# EasyEDA Pro project 电子指南针-git.eprj, board PCB6
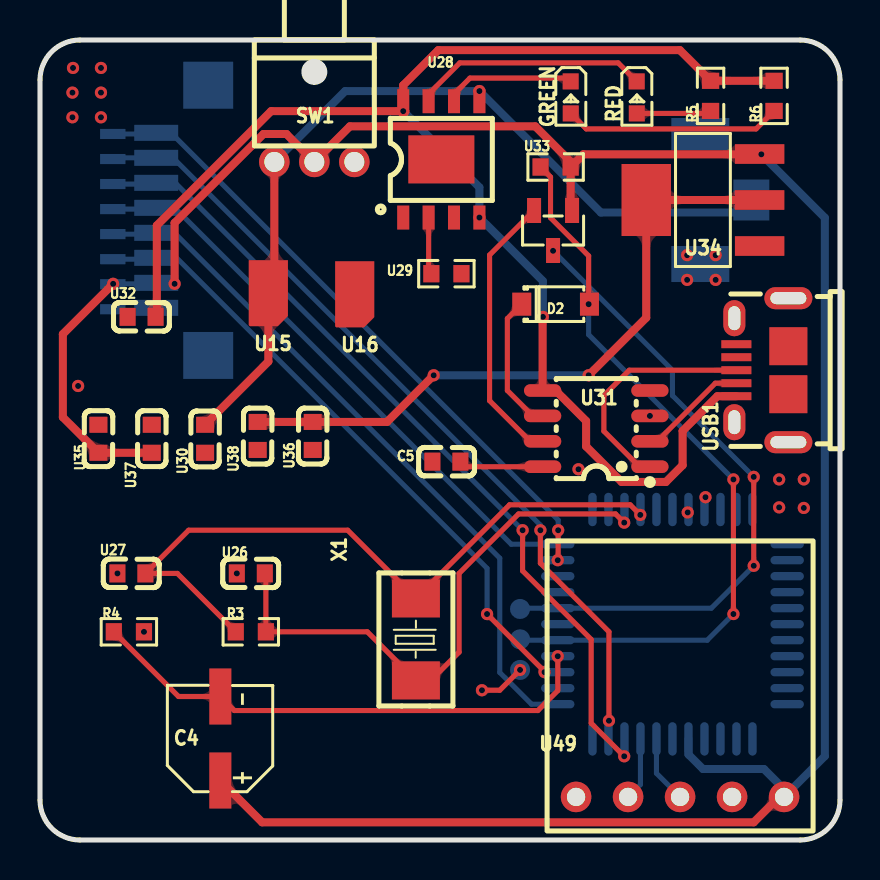
[diagram p2: board, top side]
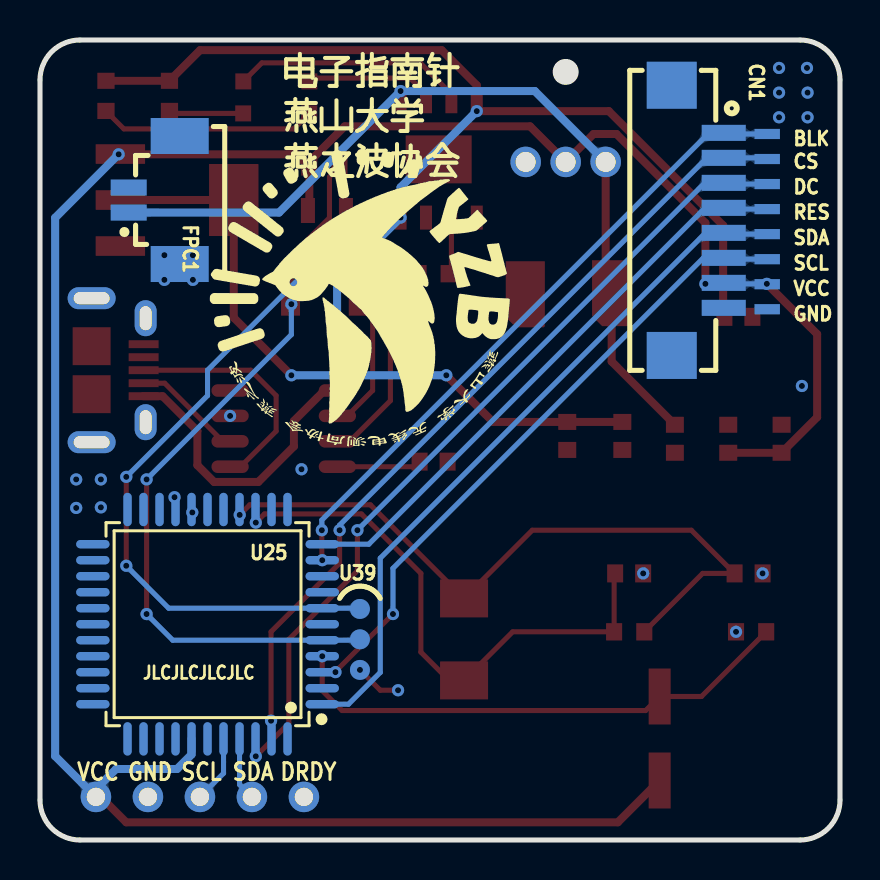
[diagram p3: board, bottom side, seen from below]

Outline 40 x 40 mm; copper layers: Top Layer, Bottom Layer. Coordinates in mm from the lower left corner of the outline.
Outline path: 0,38 0,2 arc(0.59,0.59) 2,0 38,0 arc(39.41,0.59) 40,2 40,38 arc(39.41,39.41) 38,40 2,40 arc(0.59,39.41) 0,38
Stack: Top Layer 0.035mm / Dielectric1 1.51mm FR4 er 4.5 / Bottom Layer 0.035mm

## Design rules (mm)
template: JLCPCB Capability(Two Layers Board)
spacing copperThickness1oz (default): track to track 0.102, other pairs 0.152 to 0.3
spacing copperThickness2oz: track to track 0.203, other pairs 0.152 to 0.3
track width copperThickness1oz (default): min 0.127, default 0.254, max 2.54
track width copperThickness2oz: min 0.203, default 0.254, max 2.54
differential pair differentialPair (default): width min 0.127, default 0.254, max 2.54; gap min 0.152, default 0.152
via viaSize (default): diameter min 0.5, default 0.61, max 10; hole min 0.3, default 0.305, max 6.3

## Placement (name value [footprint] x y rotation side)
BLK  -  [mini焊盘]  3.64 35.3 180 bottom
C4  10uF  [CAP-SMD_BD5.0-L5.3-W5.3-FD]  9.02 5.07 90 top
C5  100nF  [C0603]  20.32 18.92 180 top
CN1  HC-1.25-8PWT  [CONN-SMD_HC-1.25-8PWT]  7.11 30.98 270 bottom
CS  -  [mini焊盘]  3.64 34.05 180 bottom
D2  MBR0520  [SOD-123_L2.8-W1.8-LS3.7-RD]  25.78 26.79 0 top
DC  -  [mini焊盘]  3.64 32.8 180 bottom
FPC1  1.25-2PWB  [CONN-SMD_2P-P1.25_DEALON_1.25-2PWB]  34.29 32 90 bottom
GND  -  [mini焊盘]  3.64 26.54 180 bottom
GREEN  -  [LED_0603]  26.54 37.08 270 top
Q2  2SK3018  [SOT-23-3_L2.9-W1.3-P1.90-LS2.4-BR]  25.65 30.47 90 top
R3  10K  [R0603]  10.54 10.41 0 top
R4  10K  [R0603]  4.44 10.41 180 top
R5  2kΩ  [R0603]  33.53 37.21 90 top
R6  2kΩ  [R0603]  36.7 37.21 90 top
RED  -  [LED_0603]  29.84 37.08 270 top
RES  -  [mini焊盘]  3.64 31.55 180 bottom
SCL  -  [mini焊盘]  3.64 29.04 180 bottom
SDA  -  [mini焊盘]  3.64 30.29 180 bottom
SW1  XKB5858-Z-C  [SW-TH_XKB5858-Z-C]  13.72 33.9 0 top
U15  -  [小焊盘]  11.38 27.72 180 top
U16  -  [小焊盘]  15.7 27.67 180 top
U25  STC89C52RC-40I-LQFP44  [LQFP-44_L10.0-W10.0-P0.80-LS12.0-BL]  31.62 10.79 90 bottom
U26  30pF  [C0603]  10.54 13.33 0 top
U27  30pF  [C0603]  4.57 13.33 0 top
U28  TP4056  [ESOP-8_L4.9-W3.9-P1.27-LS6.0-BL-EP]  20.07 34.03 0 top
U29  1.2kΩ  [R0603]  20.32 28.32 180 top
U30  10uF  [C0603]  8.25 20.06 90 top
U31  CH340N  [SOP-8_L4.9-W3.9-P1.27-LS6.0-BL]  27.81 20.57 90 top
U32  10uF  [C0603]  5.08 26.16 0 top
U33  2kΩ  [R0603]  25.78 33.65 0 top
U34  SK12D07VG3  [SOT-223-4_L6.5-W3.5-P2.30-LS7.0-BR]  33.15 32 0 top
U35  10uF  [C0603]  2.92 20.06 270 top
U36  10uF  [C0603]  13.64 20.2 90 top
U37  1.5pF  [C0603]  5.59 20.06 270 top
U38  1.5pF  [C0603]  10.88 20.2 90 top
U39  -  [下载调试点]  24 11.04 180 bottom
U49  -  [5插件焊盘 间距2.6mm]  32 2.15 0 top
USB1  U254-051N-4BH24-S2S  [MICRO-USB-SMD_U254-051N-4BH24-S2]  36.07 23.49 90 top
VCC  -  [mini焊盘]  3.64 27.79 180 bottom
X1  11.0592MHz  [OSC-SMD_L5.0-W3.2]  18.8 10.03 270 top

## Footprints (pads in the part's own frame, mm; a bottom-side part is the same pattern mirrored in y, then rotated)
5插件焊盘 间距2.6mm
  round 1.524 hole 0.914: 1(-5.2,0) 2(-2.6,0) 3(0,0) 4(2.6,0) 5(5.2,0)
C0603
  rect 0.8x0.9 smd: 1(-0.7,0) 2(0.7,0)
CAP-SMD_BD5.0-L5.3-W5.3-FD
  rect 2.8x1.1 smd: 1(-2.1,0) 2(2.1,0)
CONN-SMD_2P-P1.25_DEALON_1.25-2PWB
  rect 0.8x1.8 smd: 1(-0.625,1.275) 2(0.625,1.275)
  rect 1.8x2.9 smd: 3(-3.2,-1.275) 4(3.2,-1.275)
CONN-SMD_HC-1.25-8PWT
  rect 0.8x2.2 smd: 1(-4.375,1.3) 2(-3.125,1.3) 3(-1.875,1.3) 4(-0.625,1.3) 5(0.625,1.3) 6(1.875,1.3) 7(3.125,1.3) 8(4.375,1.3)
  rect 2.35x2.5 smd: 9(-6.755,-1.3) 10(6.755,-1.3)
ESOP-8_L4.9-W3.9-P1.27-LS6.0-BL-EP
  rect 0.6x1.2 smd: 1(-1.905,-2.909) 2(-0.635,-2.909) 3(0.635,-2.909) 4(1.905,-2.909) 5(1.905,2.909) 6(0.635,2.909) 7(-0.635,2.909) 8(-1.905,2.909)
  rect 3.3x2.4 smd: 9(0,0)
LED_0603
  rect 0.8x0.8 smd: 1(-0.851,-0.01) 2(0.75,-0.005)
LQFP-44_L10.0-W10.0-P0.80-LS12.0-BL
  oval 0.42x1.67 smd: 1(-4,-5.735) 2(-3.2,-5.735) 3(-2.4,-5.735) 4(-1.6,-5.735) 5(-0.8,-5.735) 6(0,-5.735) 7(0.8,-5.735) 8(1.6,-5.735) 9(2.4,-5.735) 10(3.2,-5.735) 11(4,-5.735) 23(4,5.735) 24(3.2,5.735) 25(2.4,5.735) 26(1.6,5.735) 27(0.8,5.735) 28(0,5.735) 29(-0.8,5.735) 30(-1.6,5.735) 31(-2.4,5.735) 32(-3.2,5.735) 33(-4,5.735)
  oval 1.67x0.42 smd: 12(5.735,-4) 13(5.735,-3.2) 14(5.735,-2.4) 15(5.735,-1.6) 16(5.735,-0.8) 17(5.735,0) 18(5.735,0.8) 19(5.735,1.6) 20(5.735,2.4) 21(5.735,3.2) 22(5.735,4) 34(-5.735,4) 35(-5.735,3.2) 36(-5.735,2.4) 37(-5.735,1.6) 38(-5.735,0.8) 39(-5.735,0) 40(-5.735,-0.8) 41(-5.735,-1.6) 42(-5.735,-2.4) 43(-5.735,-3.2) 44(-5.735,-4)
MICRO-USB-SMD_U254-051N-4BH24-S2
  rect 0.4x1.5 smd: 1(-1.3,1.25) 2(-0.65,1.25) 3(0,1.25) 4(0.65,1.25) 5(1.3,1.25)
  oval 1.1x2.4 hole 0.6x1.8: 6(-3.6,-1.35) 6(3.6,-1.35)
  oval 1.8x1.1 hole 1.2x0.6: 6(-2.6,1.35) 6(2.6,1.35)
  rect 1.9x1.9 smd: 6(-1.2,-1.35) 6(1.2,-1.35)
mini焊盘
  custom 1.27x0.508 smd: 1(0,0)
OSC-SMD_L5.0-W3.2
  rect 1.9x2.4 smd: 1(-2.05,0) 2(2.05,0)
R0603
  rect 0.806x0.864 smd: 1(-0.753,0) 2(0.753,0)
SOD-123_L2.8-W1.8-LS3.7-RD
  rect 0.95x1.15 smd: 1(-1.692,0) 2(1.692,0)
SOP-8_L4.9-W3.9-P1.27-LS6.0-BL
  oval 0.63x1.865 smd: 1(-1.905,-2.683) 2(-0.635,-2.683) 3(0.635,-2.683) 4(1.905,-2.683) 5(1.905,2.683) 6(0.635,2.683) 7(-0.635,2.683) 8(-1.905,2.683)
SOT-23-3_L2.9-W1.3-P1.90-LS2.4-BR
  rect 1.25x0.7 smd: 1(1,-0.95) 2(1,0.95) 3(-1,0)
SOT-223-4_L6.5-W3.5-P2.30-LS7.0-BR
  rect 2.47x0.98 smd: 1(2.835,-2.3) 2(2.835,0) 3(2.835,2.3)
  rect 2.47x3.6 smd: 4(-2.835,0)
SW-TH_XKB5858-Z-C
  round 1.524 hole 1: 1(2,0) 2(0,0) 3(-2,0)
下载调试点
  round 1 smd: 1(0,0.508) 2(0,-1.01) 3(0,-2.54)
小焊盘
  custom 1.957x3.302 smd: 1(-0.037,0.381)

## Nets
3V3: U34.2 U34.4 U36.2 U38.2
GND: C5.2 CN1.8 CN1.9 CN1.10 FPC1.2 FPC1.3 FPC1.4 GND.1 R4.1 U16.1 U25.16 U26.1 U27.1 U28.1 U28.3 U28.9 U29.1 U30.1 U31.3 U32.1 U34.1 U35.1 U36.1 U37.1 U38.1 U39.3 U49.4 USB1.5 USB1.6
VCC: C4.1 CN1.7 Q2.1 SW1.2 U25.38 U33.2 U34.3 U35.2 U37.2 U49.5 VCC.1
BL_S: BLK.1 CN1.1 U25.10
CH_RXD: Q2.2 U31.7
CH_TXD: D2.1 U31.6
CS_S: CN1.2 CS.1 U25.43
D+: U31.1 USB1.3
D-: U31.2 USB1.2
DC_S: CN1.3 DC.1 U25.42
DRDY: U49.1
LED_GREEN: GREEN.1 U28.6
LED_RED: RED.1 U28.7
RES_S: CN1.4 RES.1 U25.11
RXD: D2.2 U25.5 U33.1 U39.2
SCL_C: U25.18
SCL_M: U25.40 U49.3
SCL_S: CN1.6 SCL.1 U25.3
SDA_C: U25.19
SDA_M: U25.41 U49.2
SDA_S: CN1.5 SDA.1 U25.1
TXD: Q2.3 U25.7 U39.1
VUSB: R5.2 R6.2 U28.4 U28.8 U31.5 U32.2 USB1.1
$1N5582: R3.2 U25.14 U26.2 X1.2
$1N5600: R3.1 U25.15 U27.2 X1.1
$1N5639: C4.2 R4.2 U25.4
$1N6255: U28.2 U29.2
$1N6689: C5.1 U31.8
$1N23110: FPC1.1 SW1.3 U15.1 U28.5 U30.2
$1N28229: R5.1 RED.2
$1N28235: GREEN.2 R6.1

Pads without a net: SW1 1; U25 2 6 8 9 12 13 17 20 21 22 23 24 25 26 27 28 29 30 31 32 33 34 35 36 37 39 44; U31 4; USB1 4

## Via types
v1: diameter 0.61, hole 0.305, Top Layer to Bottom Layer, 50 vias

## Routing (per net, layer and track width the routed paths; a pad name or vN(x,y) marks a point on that pad's centre or on a via; arc(x,y) is an arc through that point)
3V3: length 33.1
  Top Layer w0.4: U34.2 U34.4 30.31,26.12 v1(27.43,23.24) ; v1(19.69,23.24) 17.35,20.9 U36.2 U38.2
  Bottom Layer w0.4: v1(19.69,23.24) v1(27.43,23.24)
GND: length 2.3
  Top Layer w0.254: v1(24,8.5) 22.99,7.49 v1(22.1,7.49)
  vias: v1(1.65,38.6) v1(1.62,37.37) v1(1.62,36.13) v1(1.91,22.7) v1(3.05,38.6) v1(3.05,37.37) v1(3.05,36.13) v1(3.87,13.33) v1(5.2,10.41) v1(9.84,13.33) v1(26.92,18.54) v1(30.5,21.2) v1(32.36,29.24) v1(32.36,28.01) v1(33.78,29.24) v1(33.78,28.01) v1(36.96,18.03) v1(36.96,16.63) v1(38.19,18.03) v1(38.19,16.6)
VCC: length 125.7
  Top Layer w0.254: U34.3 36.05,34.3 v1(36.07,34.28)
  Top Layer w0.4: v1(3.66,27.81) 1.14,25.29 1.14,21.14 U35.2 U37.2 ; U33.2 27.17,34.28 35.97,34.28 U34.3 ; U33.2 26.53,31.54 Q2.1 ; U33.2 26.53,33.91 24.76,35.68 15.49,35.68 SW1.2 12.32,35.3 11.18,35.3 6.73,30.86 v1(6.73,27.81) ; C4.1 11.11,0.88 35.69,0.88 36.96,2.15 U49.5
  Bottom Layer w0.254: VCC.1 v1(3.66,27.81) 5.84,27.81 5.81,27.84 CN1.7
  Bottom Layer w0.4: CN1.7 5.86,27.81 v1(6.73,27.81) ; v1(36.07,34.28) 39.24,31.11 39.24,4.19 U49.5 37.2,2.54 36.19,3.55 33.15,3.55 32.42,4.27 U25.38
BL_S: length 32.3
  Top Layer w0.254: v1(25.89,13.99) 25.91,14.01 v1(25.91,15.49)
  Bottom Layer w0.254: v1(25.91,15.49) 25.91,16 6.55,35.36 CN1.1 5.75,35.3 BLK.1
CH_RXD: length 13.9
  Top Layer w0.254: U31.7 24.51,19.93 22.48,21.97 22.48,29.25 24.7,31.47
CH_TXD: length 6.9
  Top Layer w0.254: U31.6 24.64,21.2 23.37,22.47 23.37,26.07 D2.1
CS_S: length 40.2
  Top Layer w0.254: v1(25.02,15.49) 25.02,13.84 28.45,10.41 v1(28.45,5.96)
  Bottom Layer w0.254: v1(25.02,15.49) 25.02,15.74 6.65,34.11 CN1.2 3.7,34.11 CS.1
D+: length 11.8
  Top Layer w0.254: 34.69,23.49 29.46,23.49 28.19,22.22 28.19,20.44 29.97,18.66 U31.1
D-: length 5.4
  Top Layer w0.254: U31.2 30.86,19.93 33.77,22.84 34.69,22.84
DC_S: length 42
  Top Layer w0.254: v1(24.13,15.49) 24.13,13.46 27.56,10.03 27.56,5.84 v1(29.21,4.19)
  Bottom Layer w0.254: U25.42 29.22,4.2 v1(29.21,4.19) ; v1(24.13,15.49) 6.76,32.86 CN1.3 5.75,32.8 DC.1
LED_GREEN: length 6.6
  Top Layer w0.254: GREEN.1 26.37,38.09 21.5,38.09 20.7,37.3 U28.6
LED_RED: length 11.8
  Top Layer w0.254: U28.7 19.43,37.3 20.99,38.86 28.91,38.86 RED.1
RES_S: length 29.2
  Bottom Layer w0.254: U25.11 23.56,14.79 6.74,31.61 CN1.4 5.75,31.55 RES.1
RXD: length 37.6
  Top Layer w0.254: D2.2 v1(27.43,26.79) 27.43,29.2 25.53,31.11 25.53,33.15 U33.1 ; v1(34.67,11.3) v1(34.67,18.03)
  Bottom Layer w0.254: v1(27.43,26.79) 27.43,25.27 v1(34.67,18.03) ; v1(34.67,11.3) 33.36,9.99 U25.5 24.05,9.99 U39.2
SCL_C:
  vias: v1(32.38,16.38)
SCL_M: length 3.4
  Bottom Layer w0.254: U49.3 30.82,3.33 U25.40
SCL_S: length 31.6
  Top Layer w0.254: v1(25.23,8.39) 25.23,8.42 v1(22.35,11.3)
  Bottom Layer w0.254: SCL.1 5.75,29.04 CN1.6 6.83,29.11 22.35,13.58 v1(22.35,11.3)
SDA_C:
  vias: v1(33.27,17.14)
SDA_M: length 3.2
  Bottom Layer w0.254: U25.41 30.02,2.77 U49.2
SDA_S: length 35.4
  Bottom Layer w0.254: SDA.1 5.75,30.29 CN1.5 6.72,30.36 22.99,14.09 22.99,8.38 24.57,6.79 U25.1
TXD: length 32.5
  Top Layer w0.254: v1(35.69,18.16) v1(35.69,13.71)
  Bottom Layer w0.254: v1(35.69,13.71) 33.57,11.59 U25.7 24.04,11.59 U39.1 ; v1(25.65,29.46) 31.62,23.49 31.62,22.22 v1(35.69,18.16)
VUSB: length 72
  Top Layer w0.4: v1(18.16,36.44) 11.56,36.44 5.84,30.73 5.84,26.22 U32.2 ; v1(25.15,26.16) 25.13,26.14 U31.5 25.78,22.47 27.3,20.95 27.3,19.68 29.08,17.9 31.29,17.9 32.13,18.74 32.13,20.45 33.87,22.19 USB1.1 ; U28.8 18.16,37.74 19.91,39.49 32,39.49 R5.2 R6.2
  Bottom Layer w0.4: v1(25.15,26.16) 25.15,27.95 v1(21.97,31.12) 21.97,32.63 v1(18.16,36.44)
$1N5582: length 27.8
  Top Layer w0.254: U26.2 11.29,13.28 R3.2 16.36,10.41 X1.2 19.54,7.98 20.95,9.39 20.95,13.33 23.93,16.3 28.78,16.3 v1(29.21,15.87)
$1N5600: length 35
  Top Layer w0.254: v1(30.01,16.25) 29.51,16.76 23.48,16.76 X1.1 15.38,15.49 7.43,15.49 U27.2 6.87,13.33 R3.1
  Bottom Layer w0.254: 29.97,16.5 30,16.5 U25.15
$1N5639: length 26
  Top Layer w0.254: v1(25.89,9.19) 25.89,7.47 24.89,6.47 9.72,6.47 9.02,7.17 6.93,7.17 R4.2
$1N6255: length 2.9
  Top Layer w0.254: U29.2 19.43,28.45 U28.2
$1N6689: length 4.2
  Top Layer w0.254: C5.1 21.27,18.66 U31.8
$1N23110: length 42.4
  Top Layer w0.4: U30.2 11.42,23.92 U15.1 11.72,27.64 SW1.3
  Bottom Layer w0.4: SW1.3 15.26,37.45 v1(21.97,37.45) 28.04,31.37 FPC1.1
$1N28229: length 3.7
  Top Layer w0.254: R5.1 33.41,36.33 RED.2
$1N28235: length 10.9
  Top Layer w0.254: GREEN.2 27.31,35.55 35.81,35.55 R6.1

## Copper pours and planes (outline as drawn; the poured copper is in the pictures)
GND on Top Layer: 0.13,40.13 40,40.13 40,0.12 0.13,0.12
GND on Bottom Layer: 0,40.25 40.26,40.25 40.26,-0.13 0,-0.13

Small or netless copper shapes (teardrops, artwork), in the pictures only: 90 on Top Layer, 60 on Bottom Layer

## Text on the board
Bottom Silkscreen Layer: JLCJLCJLCJLC | DRDY | SDA | SCL | GND | VCC | 电子指南针 / 燕山大学 / 燕之波协会
